# EasyEDA Pro project 3SE_24_Power_Rune.eprj, schematic Armour_Demo1.0
Create Date: 2023-11-26; Page Name: P1; Project Name: 大符PCB; Schematic Name: Schematic1; Update Date: 2023-11-26; Company: 嘉立创EDA; Page Size: A4; Version: V1.0
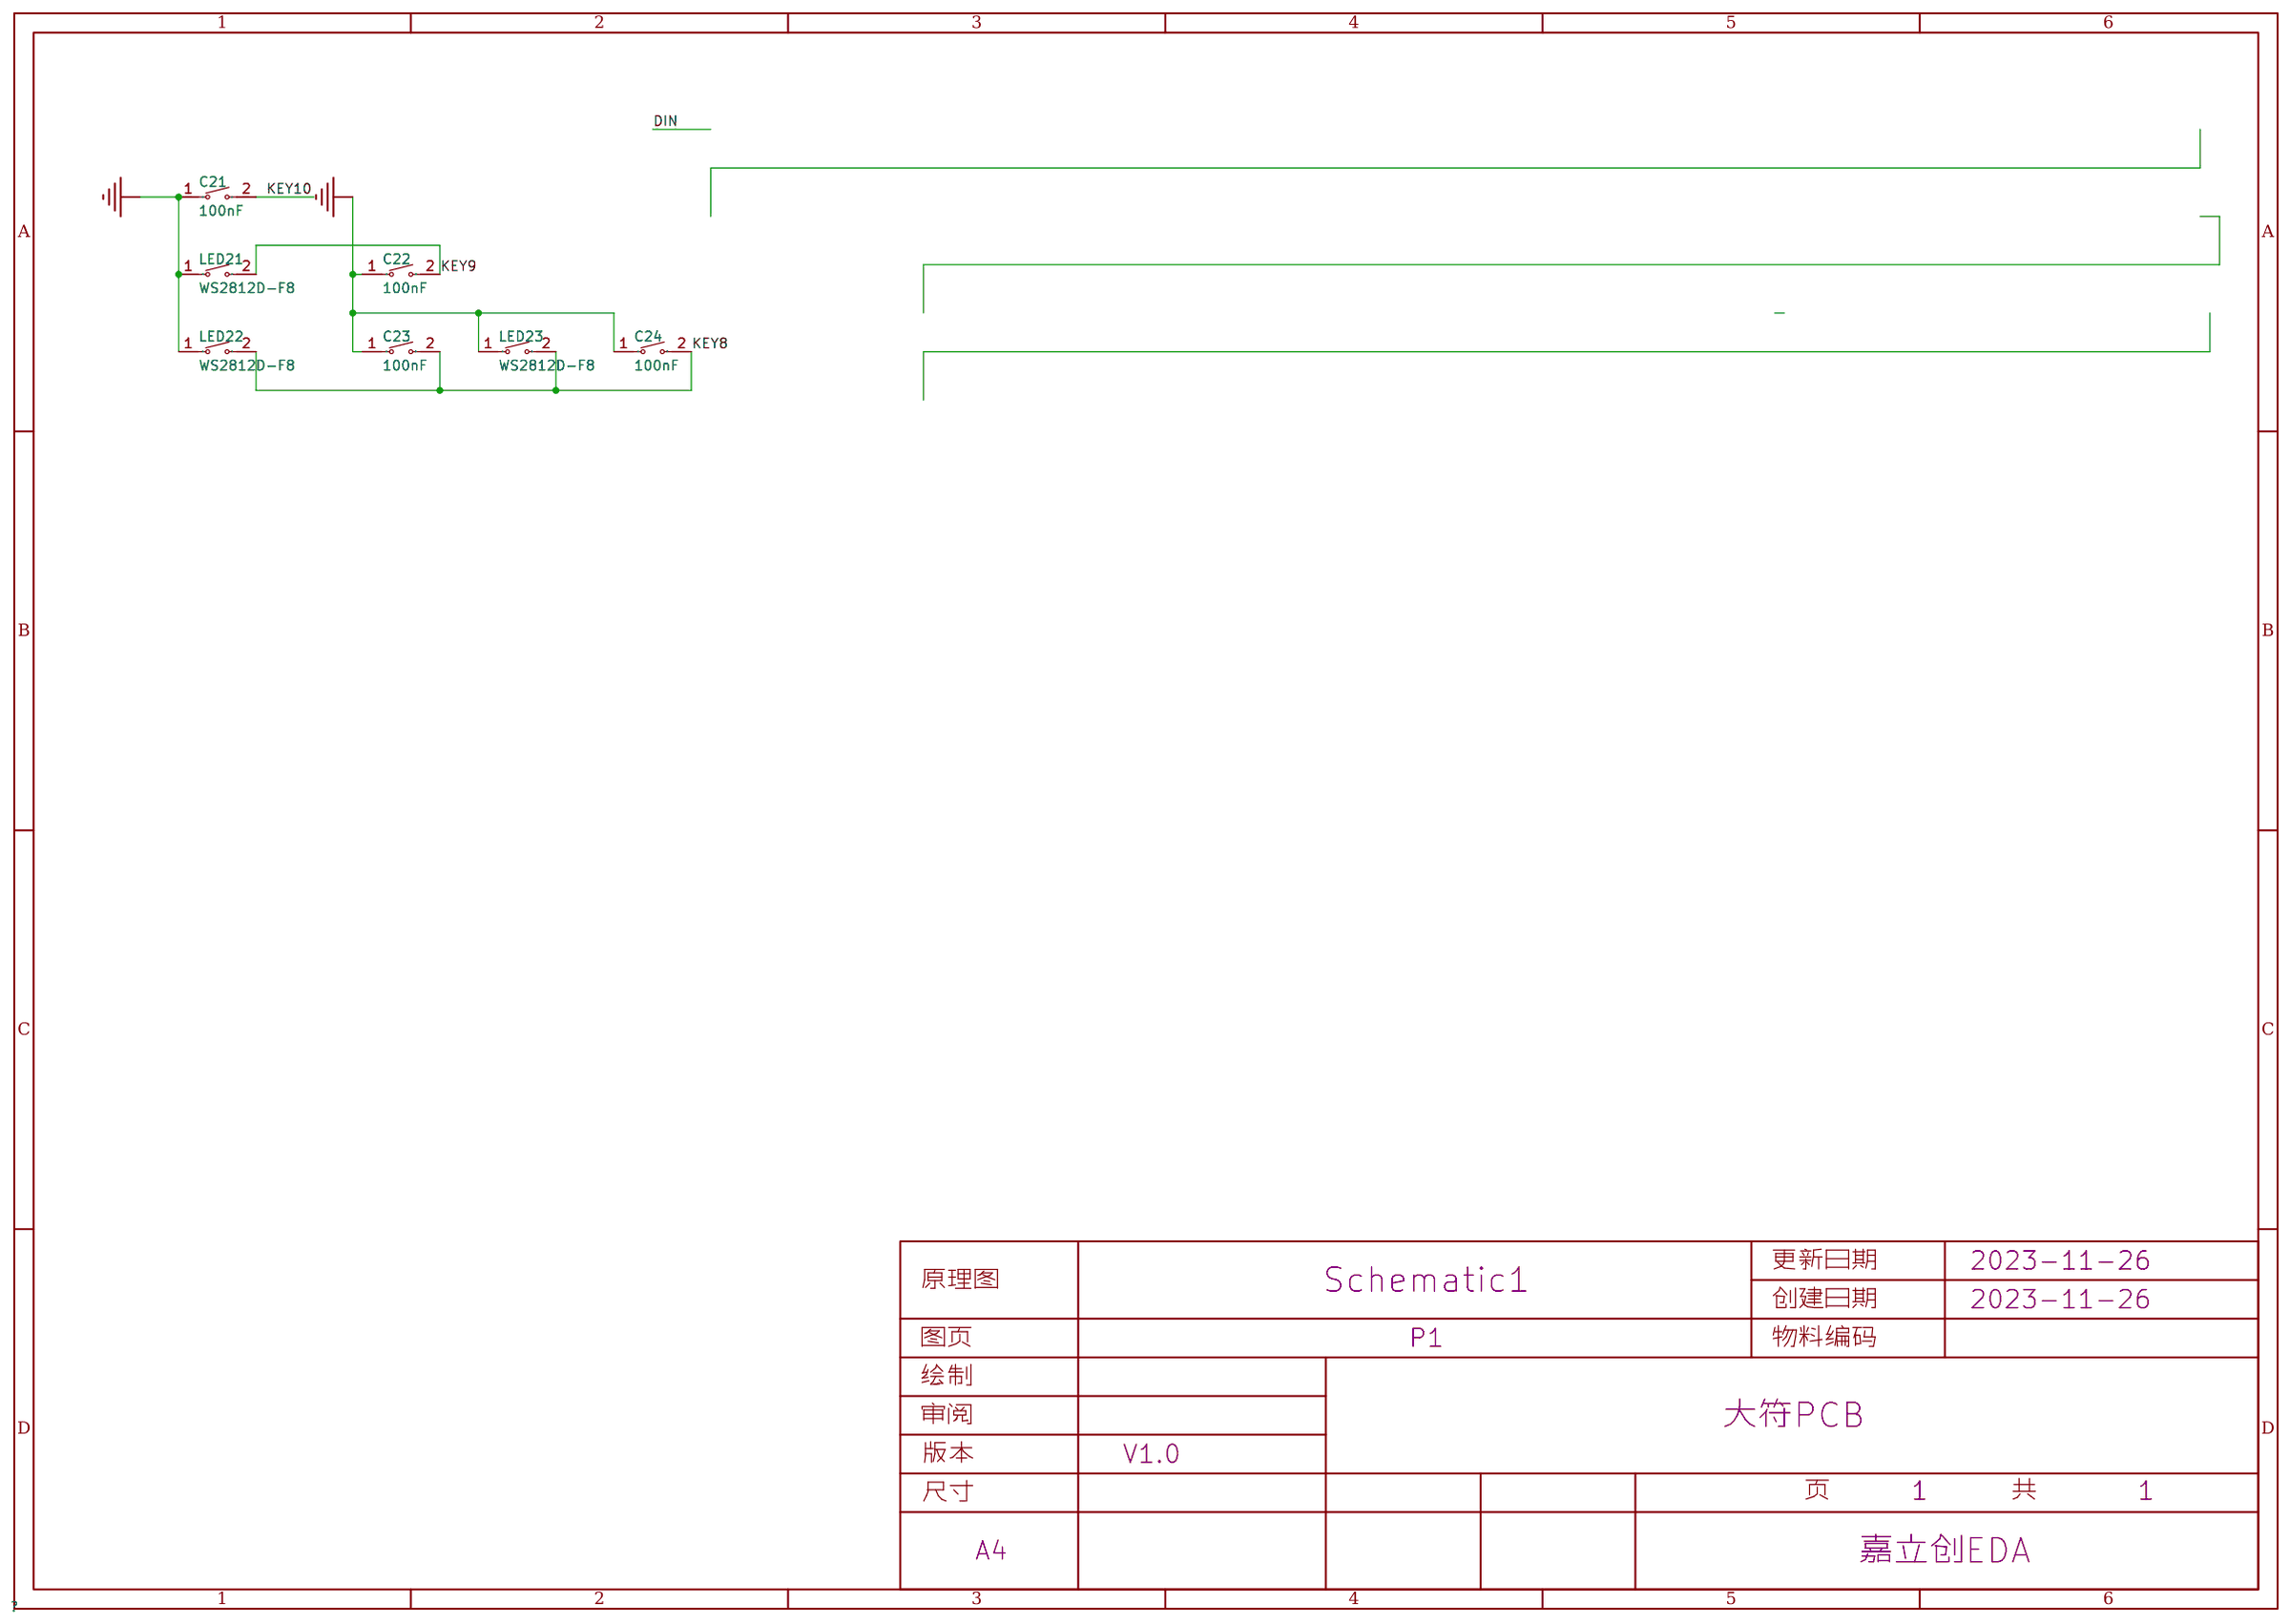
[diagram p1: schematic sheet]

## Parts
C21  100nF  [C0603]
C22  100nF  [C0603]
C23  100nF  [C0603]
C24  100nF  [C0603]
CBB1  -
CBB2  -
CBB3  -
CBB4  -
CBB5  -
CBB6  -
CBB7  -
CBB8  -
CBB9  -
CBB10  -
CBB11  -
CBB12  -
CBB13  -
CBB14  -
CBB15  -
CBB16  -
CBB17  -
CBB18  -
CBB19  -
CBB20  -
CBB21  -
CBB22  -
CBB23  -
CBB24  -
LED21  WS2812D-F8  [LED-TH_WS2812D-F8]
LED22  WS2812D-F8  [LED-TH_WS2812D-F8]
LED23  WS2812D-F8  [LED-TH_WS2812D-F8]

## Library data of the parts
C21-C24 = 0603B104K500NT: 容值:100nF;精度:±10%;额定电压:50V;材质(温度系数):X7R;; LCSC Part Name: 100nF ±10% 50V; Supplier Part: C30926; Manufacturer: FH(风华); Supplier Footprint: 0603; JLCPCB Part Class: Extended Part; Datasheet: https://atta.szlcsc.com/upload/public/pdf/source/20170923/C30926_1506149436298988724.pdf; Supplier: LCSC; Tolerance: ±10%; Voltage Rated: 50V; Temperature Coefficient: X7R; Standardization Check: true
LED21-LED23 = WS2812D-F8: 发光颜色:RGB三色;; LCSC Part Name: RGB三色; Supplier Part: C139126; Manufacturer: worldsemi; Supplier Footprint: 插件,D=5mm; JLCPCB Part Class: Extended Part; Datasheet: https://atta.szlcsc.com/upload/public/pdf/source/20171116/C139126_15108221280701123735.pdf; Supplier: LCSC; Emitted Color: RGB三色; Lamp Holder Type: 5mm圆形灯头

## Nets
GND: C21.1 C22.1 C23.1 C24.1 LED21.1 LED22.1 LED23.1
KEY8: C23.2 C24.2 LED22.2 LED23.2
KEY9: C22.2 LED21.2
KEY10: C21.2

Not connected (* = marked no-connect by the designer): CBB1 1(DI) 2(DO); CBB2 1(DI) 2(DO); CBB3 1(DI) 2(DO); CBB4 1(DI) 2(DO); CBB5 1(DI) 2(DO); CBB6 1(DI) 2(DO); CBB7 1(DI) 2(DO); CBB8 1(DI) 2(DO); CBB9 1(DI) 2(DO); CBB10 1(DI) 2(DO); CBB11 1(DI) 2(DO); CBB12 1(DI) 2(DO); CBB13 1(DI) 2(DO); CBB14 1(DI) 2(DO); CBB15 1(DI) 2(DO); CBB16 1(DI) 2(DO); CBB17 1(DI) 2(DO); CBB18 1(DI) 2(DO); CBB19 1(DI) 2(DO); CBB20 1(DI) 2(DO); CBB21 1(DI) 2(DO); CBB22 1(DI) 2(DO); CBB23 1(DI) 2(DO); CBB24 1(DI) 2(DO)
